# EasyEDA Pro project MSDRV3.eprj, board BBC_SCHEM
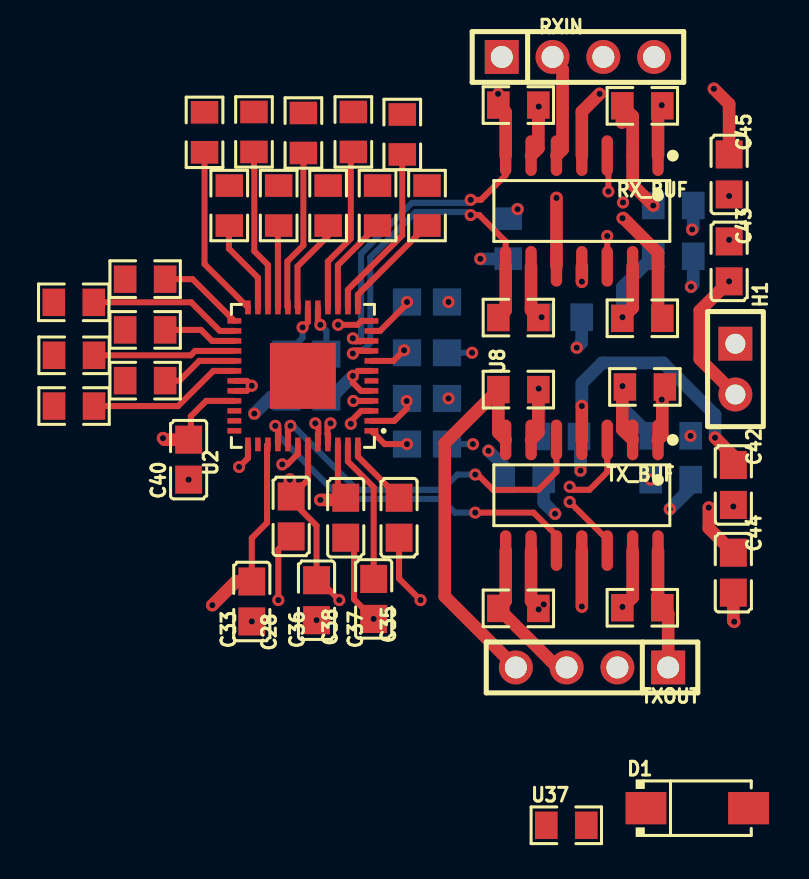
[diagram p8: board, top side]
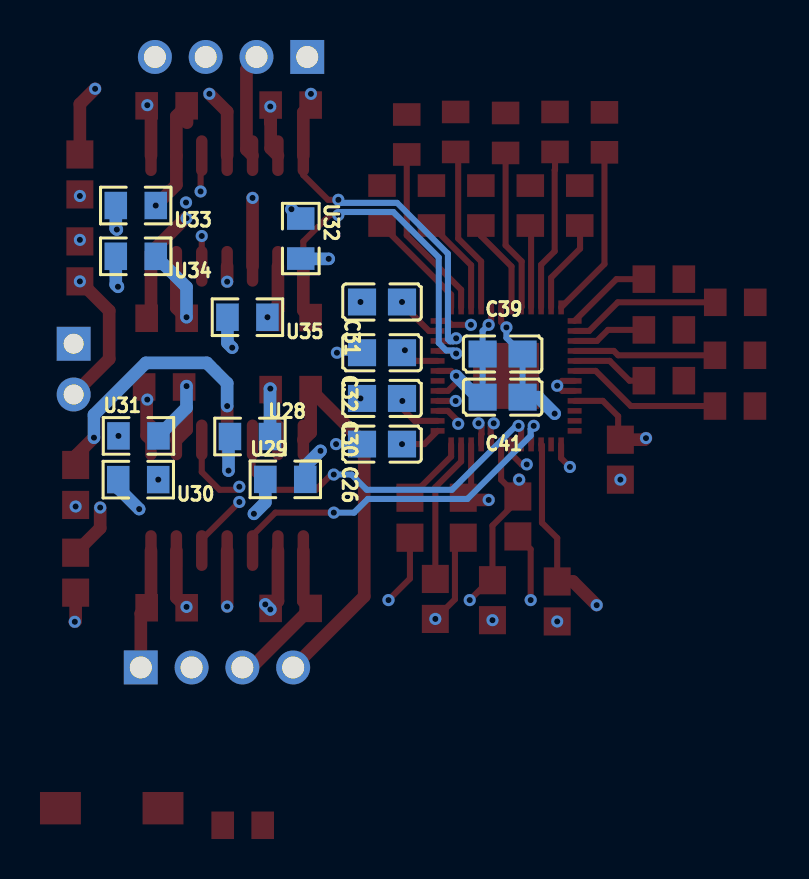
[diagram p9: board, bottom side, seen from below]

No outline. copper layers: Top Layer, GND, inner3, Inner, VCC, Bottom Layer. Coordinates in mm from the lowest, leftmost part position.
Stack: Top Layer 0.035mm 外层铜厚1oz / Dielectric1 0.0994mm 3313 RC57% 4.2mil / GND 0.035mm - / Dielectric2 0.55mm 0.55mm H/H不含铜 / inner3 0.035mm - / Dielectric3 0.1088mm 2116 RC54% 4.9mil / Inner 0.035mm - / Dielectric4 0.55mm 0.55mm H/H不含铜 / VCC 0.0152mm 内层铜厚 / Dielectric5 0.0994mm 3313 RC57% 4.2mil / Bottom Layer 0.035mm 外层铜厚1oz

## Design rules (mm)
template: JLCPCB Capability(Two Layers Board)
spacing copperThickness1oz (default): track to track 0.102, other pairs 0.152 to 0.3
spacing copperThickness2oz: track to track 0.203, other pairs 0.152 to 0.3
track width copperThickness1oz (default): min 0.127, default 0.254, max 2.54
track width copperThickness2oz: min 0.203, default 0.254, max 2.54
differential pair differentialPair (default): width min 0.127, default 0.254, max 2.54; gap min 0.152, default 0.152
via viaSize (default): diameter min 0.5, default 0.61, max 10; hole min 0.3, default 0.305, max 6.3

## Placement (name value [footprint] x y rotation side)
C26  330nF  [C0805]  17.67 19.07 180 bottom
C28  100nF  [C0805]  10.87 15.45 90 top
C30  100nF  [C0805]  17.67 21.36 0 bottom
C31  100nF  [C0805]  17.67 26.18 180 bottom
C32  100nF  [C0805]  17.67 23.64 180 bottom
C33  100nF  [C0805]  8.91 11.2 270 top
C35  330nF  [C0805]  16.27 15.39 270 top
C36  100nF  [C0805]  12.14 11.26 90 top
C37  330nF  [C0805]  15 11.33 90 top
C38  100nF  [C0805]  13.61 15.39 90 top
C39  100nF  [C0805]  11.64 23.58 180 bottom
C40  100nF  [C0805]  5.75 18.29 90 top
C41  100nF  [C0805]  11.64 21.42 180 bottom
C42  330nF  [C0805]  32.99 17.03 90 top
C43  330nF  [C0805]  32.78 28.22 270 top
C44  330nF  [C0805]  32.99 12.64 270 top
C45  330nF  [C0805]  32.78 32.57 90 top
D1  -  [SMA_L4.4-W2.8-LS5.4-RD]  31.19 0.85 0 top
H1  -  [HDR-TH_2P-P2.54-V-F]  33.09 22.83 270 top
RX_BUF  CLC4601ISO14X  [SOIC-14_L8.7-W3.9-P1.27-LS6.0-BL]  25.42 30.74 180 top
RXIN  -  [HDR-TH_4P-P2.54-V-F]  25.22 38.45 0 top
TX_BUF  CLC4601ISO14X  [SOIC-14_L8.7-W3.9-P1.27-LS6.0-BL]  25.42 16.51 180 top
TXOUT  -  [HDR-TH_4P-P2.54-V-F]  25.92 7.9 180 top
U2  MAX5864ETM+  [qfn-48_l7.0-w7.0-p0.50-bl-ep5.1]  11.46 22.49 90 top
U3  1120  [R0805]  22.24 10.85 0 top
U4  1120  [R0805]  28.44 36 0 top
U5  1120  [R0805]  28.44 25.37 180 top
U6  1120  [R0805]  22.24 25.41 0 top
U7  1120  [R0805]  22.24 36.04 180 top
U8  1120  [R0805]  22.24 21.8 180 top
U10  1120  [R0805]  28.44 10.88 180 top
U11  100  [R0805]  0.02 20.98 0 top
U12  100  [R0805]  3.57 22.25 0 top
U13  100  [R0805]  0.02 23.52 0 top
U14  100  [R0805]  3.57 24.79 0 top
U15  100  [R0805]  0 26.17 0 top
U16  100  [R0805]  3.57 27.33 0 top
U17  100  [R0805]  6.54 34.67 90 top
U18  100  [R0805]  7.78 31.01 90 top
U19  100  [R0805]  9.02 34.69 90 top
U20  100  [R0805]  10.25 31.01 90 top
U21  100  [R0805]  11.49 34.64 90 top
U22  100  [R0805]  12.72 31.01 90 top
U23  100  [R0805]  13.99 34.69 90 top
U24  100  [R0805]  15.2 31.01 90 top
U25  100  [R0805]  16.43 34.57 90 top
U26  100  [R0805]  17.67 31.01 90 top
U28  1120  [R0805]  24.27 19.45 0 bottom
U29  1120  [R0805]  22.51 17.31 180 bottom
U30  1120  [R0805]  29.86 17.29 0 bottom
U31  1120  [R0805]  29.85 19.48 180 bottom
U32  1120  [R0805]  21.73 29.36 270 bottom
U33  1120  [R0805]  29.99 31.01 0 bottom
U34  1120  [R0805]  29.99 28.47 0 bottom
U35  1120  [R0805]  24.4 25.42 0 bottom
U36  1120  [R0805]  28.57 21.93 0 top
U37  1120  [R0805]  24.64 0 0 top

## Footprints (pads in the part's own frame, mm; a bottom-side part is the same pattern mirrored in y, then rotated)
C0805
  rect 1.41x1.35 smd: 1(-1,0) 2(1,0)
HDR-TH_2P-P2.54-V-F
  rect 1.7x1.7 hole 1: 1(-1.27,0)
  round 1.7 hole 1: 2(1.27,0)
HDR-TH_4P-P2.54-V-F
  rect 1.7x1.7 hole 1.1: 1(-3.81,0)
  round 1.7 hole 1.1: 2(-1.27,0) 3(1.27,0) 4(3.81,0)
qfn-48_l7.0-w7.0-p0.50-bl-ep5.1
  rect 0.28x0.7 smd: 1(-2.75,-3.428) 2(-2.25,-3.428) 3(-1.75,-3.428) 4(-1.25,-3.428) 5(-0.75,-3.428) 6(-0.25,-3.428) 7(0.25,-3.428) 8(0.75,-3.428) 9(1.25,-3.428) 10(1.75,-3.428) 11(2.25,-3.428) 12(2.75,-3.428) 25(2.75,3.428) 26(2.25,3.428) 27(1.75,3.428) 28(1.25,3.428) 29(0.75,3.428) 30(0.25,3.428) 31(-0.25,3.428) 32(-0.75,3.428) 33(-1.25,3.428) 34(-1.75,3.428) 35(-2.25,3.428) 36(-2.75,3.428)
  rect 0.7x0.28 smd: 13(3.428,-2.75) 14(3.428,-2.25) 15(3.428,-1.75) 16(3.428,-1.25) 17(3.428,-0.75) 18(3.428,-0.25) 19(3.428,0.25) 20(3.428,0.75) 21(3.428,1.25) 22(3.428,1.75) 23(3.428,2.25) 24(3.428,2.75) 37(-3.428,2.75) 38(-3.428,2.25) 39(-3.428,1.75) 40(-3.428,1.25) 41(-3.428,0.75) 42(-3.428,0.25) 43(-3.428,-0.25) 44(-3.428,-0.75) 45(-3.428,-1.25) 46(-3.428,-1.75) 47(-3.428,-2.25) 48(-3.428,-2.75)
  rect 3.302x3.302 smd: 49(0,0)
R0805
  rect 1.133x1.377 smd: 1(-1,0) 2(1,0)
SMA_L4.4-W2.8-LS5.4-RD
  rect 2.046x1.62 smd: 1(-2.566,0) 2(2.566,0)
SOIC-14_L8.7-W3.9-P1.27-LS6.0-BL
  oval 0.574x2.038 smd: 1(-3.81,-2.769) 2(-2.54,-2.769) 3(-1.27,-2.769) 4(0,-2.769) 5(1.27,-2.769) 6(2.54,-2.769) 7(3.81,-2.769) 8(3.81,2.769) 9(2.54,2.769) 10(1.27,2.769) 11(0,2.769) 12(-1.27,2.769) 13(-2.54,2.769) 14(-3.81,2.769)

## Nets
As in the schematic, except:
GND: C26.1 C28.1 C30.2 C31.1 C32.1 C33.2 C35.2 C36.1 C37.1 C38.1 C39.1 C40.1 C41.1 C42.1 C43.1 C44.1 C45.1 U2.5 U2.7 U2.12 U2.17 U2.31 U2.32 U2.37 U2.42 U28.2 U29.2 U30.2 U31.1 U32.2 U33.2 U34.2 U35.2 U37.1
$1N9382: D1.2 TX_BUF.2 U31.2 U36.1
$1N30465: D1.1 U37.2

Pads without a net: U2 38 49

## Via types
v1: diameter 0.61, hole 0.305, Top Layer to Bottom Layer, 81 vias

## Routing (per net, layer and track width the routed paths; a pad name or vN(x,y) marks a point on that pad's centre or on a via; arc(x,y) is an arc through that point)
+5V: length 47
  Top Layer w0.635: TX_BUF.4 v1(25.42,20.98) ; v1(26.31,36.6) 25.42,35.71 RX_BUF.4 ; v1(32.08,19.4) 32.95,18.52 32.95,18.03 ; C45.2 32.78,36.09 v1(32.02,36.85)
  inner3 w0.635: v1(32.02,36.85) 26.56,36.85 v1(26.31,36.6)
  Inner w0.635: v1(32.02,36.85) 32.4,36.85 34.49,34.76 34.49,25.49 H1.1 31.44,22.44 31.44,20.41 32.08,19.78 v1(32.08,19.4)
  Bottom Layer w0.635: v1(25.42,20.98) 25.42,22.12 26.43,23.14 29.48,23.14 32.08,20.54 v1(32.08,19.4)
-5V: length 41.4
  Top Layer w0.635: C44.2 32.99,10.23 v1(33.04,10.18) ; H1.2 31.32,23.33 31.32,25.75 v1(32.78,27.22) ; v1(25.42,27.2) 25.42,27.97 ; 25.42,10.95 TX_BUF.11
  inner3 w0.635: v1(25.42,27.2) 26.81,28.6 31.4,28.6 v1(32.78,27.22) ; v1(25.42,10.94) 25.67,10.94 26.81,9.8 29.23,9.8 29.61,10.18 v1(33.04,10.18)
  Inner w0.635: v1(33.04,10.18) 34.49,11.64 34.49,19.78 33.09,21.17 H1.2
GND: length 43.6
  Top Layer w0.305: U2.32 8.65,21.74 v1(8.91,21.99) 8.66,22.24 8.03,22.24 ; v1(15,10.33) 14.02,11.31 14.02,13.97 C38.1 ; C28.1 10.23,13.81 v1(10.23,11.27) ; C35.2 16.27,12.34 v1(17.35,11.27) ; v1(13.22,25.04) 14.19,25.04 14.39,25.24 U2.12 ; U2.7 14.21,22.74 v1(13.96,22.49) 13.96,22.15 14.37,21.74 U2.5 ; v1(10.43,18.06) 10.68,18.06 11.21,18.58 U2.42 ; U2.17 12.21,25.16 v1(12.34,25.04) ; U2.37 8.71,18.37 v1(8.27,17.93)
  Top Layer w0.635: C44.1 31.77,14.87 v1(31.77,15.9)
  Bottom Layer w0.305: v1(12.34,25.04) 12.64,24.74 C39.1 C41.1 ; v1(19.97,19.07) C26.1 ; v1(19.92,23.64) C32.1
  Bottom Layer w0.635: C41.1 12.9,21.42 v1(13.96,22.49) ; U30.2 30.86,16.87 v1(29.82,15.82) ; U35.2 25.4,24.14 v1(25.16,23.9) ; v1(30.88,26.95) 30.99,27.06 U34.2 ; v1(20.34,28.34) 21.72,28.34 U32.2 ; v1(20.75,18.74) 21.51,17.98 U29.2 ; U28.2 25.35,19.38 v1(25.35,17.75) ; v1(30.93,29.81) 30.99,29.86 U33.2
  vias: v1(5.75,17.29) v1(8.91,10.2) v1(12.14,10.26) v1(18.75,26.18) v1(18.75,21.36) v1(30.85,19.48) v1(32.78,31.49) v1(32.78,29.29) v1(32.99,15.95)
3.3: length 42.7
  Top Layer w0.305: v1(16.67,26.18) 16.67,26.08 15.32,24.74 U2.11 ; 14.89,23.24 15.99,23.24 v1(16.53,23.77) ; 14.89,20.24 16.04,20.24 16.65,20.85 v1(16.65,21.23) ; 8.03,21.24 6.62,21.24 5.86,20.47 5.86,19.41 C40.2 ; v1(13.28,11.27) 12.29,12.26 C36.2 12.14,14.99 10.87,16.26 C28.2 11.71,17.29 U2.43 ; 13.46,16.53 13.21,16.78 U2.46 ; U2.39 9.67,19.01 9.67,15.14 8.91,14.37 C33.1 ; U2.18 11.71,25.18 v1(11.45,24.91)
  Top Layer w0.635: C38.2 13.46,16.53 13.21,16.28 v1(12.34,16.28) ; v1(10.81,17.29) 10.81,16.52 C28.2 ; v1(4.47,19.37) 4.54,19.29 C40.2 ; v1(6.93,11.01) 8.12,12.2 C33.1
  Bottom Layer w0.305: C41.2 C39.2 11.45,24.39 v1(11.45,24.91)
  Bottom Layer w0.635: C41.2 9.86,21.42 v1(9.03,20.6) ; C32.2 16.65,23.64 v1(16.53,23.77) ; v1(16.65,21.23) 16.67,21.25 C30.1
BBC_IN: length 18.9
  Top Layer w0.305: U2.44 12.21,19.56 12.23,19.58 12.23,19.96 v1(12.08,20.11) ; v1(24.81,16.18) 26.69,14.3 TX_BUF.12
  inner3 w0.305: v1(12.08,20.11) 12.23,19.96 12.23,19.62 15.52,16.33 24.65,16.33 v1(24.81,16.18)
BBC_IP: length 18.8
  Top Layer w0.305: U2.45 12.71,19.56 12.69,19.58 12.69,19.96 v1(12.84,20.11) ; TX_BUF.3 26.69,17.67 25.8,16.79 24.96,16.79 v1(24.81,16.94)
  inner3 w0.305: v1(12.84,20.11) 12.69,19.96 12.69,19.81 15.71,16.79 24.65,16.79 v1(24.81,16.94)
BBC_QN: length 18.3
  Top Layer w0.305: v1(20.08,15.64) 23,15.64 24.15,14.5 24.15,13.75 ; U2.40 10.21,19.56 10.23,19.58 10.23,19.83 v1(10.08,19.99)
  Bottom Layer w0.305: v1(10.08,19.99) 10.23,19.83 10.23,19.49 13.4,16.33 18.38,16.33 19.07,15.64 v1(20.08,15.64)
BBC_QP: length 18.2
  Top Layer w0.305: 24.15,19.28 24.15,17.69 23.25,16.79 20.97,16.79 20.21,17.55 v1(20.08,17.55) ; v1(10.84,19.99) 10.71,19.86 U2.41
  Bottom Layer w0.305: v1(10.84,19.99) 10.97,19.99 14.17,16.79 18.43,16.79 19.19,17.55 v1(20.08,17.55)
RX_BBCIN: length 26.8
  Top Layer w0.305: 14.89,21.24 14.88,21.23 v1(13.99,21.23)
  Top Layer w0.635: 29.41,36.03 U4.2 29.23,35.78 RX_BUF.1
  inner3 w0.305: v1(13.99,21.23) 14,21.22 14.27,21.22 15.81,22.76 16.65,22.76 24.91,31.01 27.32,31.01 v1(27.47,31.16) 27.49,31.18
  inner3 w0.635: v1(29.41,36.03) 29.23,35.85 29.23,32.91 27.49,31.18
RX_BBCIP: length 25.2
  Top Layer w0.305: 27.49,30.39 27.46,30.39 v1(27.45,30.38) ; v1(13.86,20.09) 13.86,20.22 14.38,20.74 U2.3
  Top Layer w0.635: 27.49,30.39 29.23,28.65 RX_BUF.14 29.23,25.59 U5.1
  inner3 w0.305: v1(13.86,20.09) 14.2,20.09 16.41,22.3 16.84,22.3 25.1,30.55 27.27,30.55 v1(27.45,30.38)
RX_BBCQN: length 18.7
  Top Layer w0.305: U2.9 14.39,23.74 14.37,23.76 14.11,23.76 v1(13.96,23.61) ; v1(19.85,30.54) 20.28,30.54 21.61,29.21 RX_BUF.8
  Top Layer w0.635: U6.1 21.61,25.77 RX_BUF.8
  Bottom Layer w0.305: v1(13.96,23.61) 14.11,23.76 14.45,23.76 14.83,24.13 14.83,28.41 17.1,30.69 19.7,30.69 v1(19.85,30.54)
RX_BBCQP: length 18.9
  Top Layer w0.305: U2.10 14.39,24.24 14.37,24.22 14.11,24.22 v1(13.96,24.37) ; v1(19.85,31.3) 20.37,31.3 21.61,32.53 RX_BUF.7 ; v1(21.23,36.6) 21.23,36.05 U7.2
  Top Layer w0.635: RX_BUF.7 21.61,35.67 U7.2
  Bottom Layer w0.305: v1(19.85,31.3) 19.7,31.14 16.91,31.14 14.37,28.6 14.37,24.32 14.27,24.22 14.11,24.22 v1(13.96,24.37)
RXIN: length 9.9
  Top Layer w0.305: 26.74,31.72 26.74,33.45 RX_BUF.3
  Inner w0.635: 28.97,38.88 28.97,38.39 28.52,37.94 28.52,33.49 v1(26.74,31.72)
RXIP: length 11.4
  Top Layer w0.305: 26.69,29.49 RX_BUF.12
  Inner w0.635: RXIN.3 26.49,37.88 25.43,36.82 25.43,30.74 v1(26.69,29.49)
RXQN: length 11.8
  Top Layer w0.635: v1(24.15,31.39) 24.15,27.97
  Inner w0.635: RXIN.1 21.79,38.45 22.11,38.12 22.11,33.42 v1(24.15,31.39)
RXQP: length 5.7
  Top Layer w0.635: 23.89,38.88 23.89,38.38 24.45,37.82 24.45,33.81 RX_BUF.5
TXIN: length 6.1
  Top Layer w0.635: TXOUT.1 29.73,10.59 U10.1 29.23,11.1 TX_BUF.14
TXIP: length 17.7
  Top Layer w0.635: U36.2 29.57,21.59 29.44,21.46 29.44,21.33 ; 29.44,21.33 29.44,19.5 TX_BUF.1 ; 29.44,21.33 v1(29.41,21.3)
  Inner w0.635: v1(29.41,21.3) 29.41,20.03 26.49,17.11 26.49,8.6 TXOUT.2
TXQN: length 7.7
  Top Layer w0.635: TXOUT.3 24.2,7.9 U3.1 21.61,11.22 TX_BUF.8
TXQP: length 19.2
  Top Layer w0.635: TXOUT.4 18.56,11.45 18.56,19.12 U8.2 21.24,19.65 TX_BUF.7
$1N3982: length 7.3
  Top Layer w0.305: U2.47 13.71,18.2 15,16.91 C37.2
$1N8783: length 6.5
  Top Layer w0.635: 27.42,35.16 27.42,35.98 U4.1 27.96,35.49 RX_BUF.2 27.96,32.04 v1(28.99,31.01)
$1N8787: length 11.3
  Top Layer w0.635: 23.26,35.47 23.29,35.99 U7.1 23.24,35.16 ; 23.26,35.47 v1(23.26,35.96) ; 23.26,35.47 23.24,35.16 ; 23.26,35.47 23.26,35.18 23.24,35.16 ; RX_BUF.6 23.24,33.87 23.24,35.16
  inner3 w0.635: U32.1 v1(22.2,30.83) 23.26,31.88 v1(23.26,35.96)
  Bottom Layer w0.635: v1(22.2,30.83) U32.1
$1N8791: length 3.7
  Top Layer w0.635: 23.29,25.65 23.24,25.6 23.24,25.58 ; 23.24,25.58 22.88,25.95 ; 23.24,25.58 v1(23.4,25.42) ; 23.24,25.58 U6.2 22.88,25.77 22.88,25.95 ; 22.88,25.95 RX_BUF.9
$1N8799: length 6.6
  Top Layer w0.635: RX_BUF.13 27.96,25.88 U5.2 27.44,25.42 v1(27.45,25.42)
  Bottom Layer w0.635: v1(27.45,25.42) 27.45,26.93 U34.1
$1N9382: length 6
  Top Layer w0.635: TX_BUF.2 27.44,19.8 27.44,21.97 v1(27.45,21.98)
  Bottom Layer w0.635: v1(27.45,21.98) 27.45,20.89 U31.2
$1N9385: length 5.1
  Top Layer w0.635: TX_BUF.6 23.24,19.65 U8.1 23.26,21.82 v1(23.26,21.85)
  Bottom Layer w0.635: v1(23.26,21.85) 23.27,21.83 U28.1
$1N9388: length 10.1
  Top Layer w0.635: TX_BUF.13 27.96,11.4 U10.2 27.44,10.92 v1(27.45,10.93)
  Inner w0.635: v1(27.45,10.93) 28.86,12.34 v1(28.86,17.29)
$1N9391: length 10.2
  Top Layer w0.635: v1(23.26,10.8) 23.24,10.82 U3.2 22.88,11.22 TX_BUF.9
  Inner w0.635: v1(24.08,15.59) 24.08,11.62 v1(23.51,11.05)
  Bottom Layer w0.635: v1(24.08,15.59) 23.51,16.16 U29.1 ; v1(23.51,11.05) v1(23.26,10.8)
$1N10591: length 7.7
  Top Layer w0.305: U11.2 5.22,20.98 6.98,22.74 U2.30
$1N10629: length 3.9
  Top Layer w0.305: 8.03,23.24 6.28,23.24 5.29,22.25 U12.2
$1N10667: length 7.1
  Top Layer w0.305: U2.28 6.08,23.74 5.86,23.52 U13.2
$1N10705: length 3.7
  Top Layer w0.305: U14.2 6.37,24.79 6.92,24.24 U2.27
$1N10743: length 7.6
  Top Layer w0.305: U15.2 5.87,26.17 7.31,24.74 U2.26
$1N10781: length 4.3
  Top Layer w0.305: U2.25 5.94,27.33 U16.2
$1N10830: length 8.5
  Top Layer w0.305: 6.54,33.55 6.54,28.08 U2.24
$1N10868: length 4.7
  Top Layer w0.305: U2.23 9.21,27.4 7.76,28.85 7.76,30 U18.1
$1N10906: length 8.1
  Top Layer w0.305: U2.22 9.71,28.05 9.03,28.72 9.03,32.79 9.02,32.81 U19.1
$1N10944: length 4.1
  Top Layer w0.305: U20.1 10.21,29.97 U2.21
$1N10982: length 8.1
  Top Layer w0.305: U21.1 11.49,29.02 10.68,28.22 10.68,25.94 U2.20
$1N11020: length 4.7
  Top Layer w0.305: U22.1 12.72,29.49 11.19,27.96 11.19,25.93 U2.19
$1N11058: length 8.2
  Top Layer w0.305: U2.16 12.71,28.21 13.86,29.36 13.86,33.54 13.96,33.64
$1N11162: length 4.9
  Top Layer w0.305: U2.15 13.21,28.03 U24.1
$1N11200: length 8.8
  Top Layer w0.305: U2.14 13.71,26.8 16.43,29.52 U25.1
$1N11238: length 5.5
  Top Layer w0.305: U2.13 14.21,26.55 U26.1
$1N11679: length 3.5
  Top Layer w0.305: U2.48 14.21,18.45 C35.1
$1N11690: length 2.1
  Top Layer w0.305: v1(16.67,19.07) 15.55,19.07 U2.1
